# EasyEDA Pro project URADORRY-SUN.eprj, schematic Sub - MAX3421E/Rev1.0
Create Date: 2024-05-30; Page Name: base; Project Name: URADORRY-SUN; Schematic Name: Sub - MAX3421E/Rev1.0; Update Date: 2024-06-01; Add into BOM: yes; Company: 整数71の情報処理; Convert to PCB: yes; Drawed: 整数71
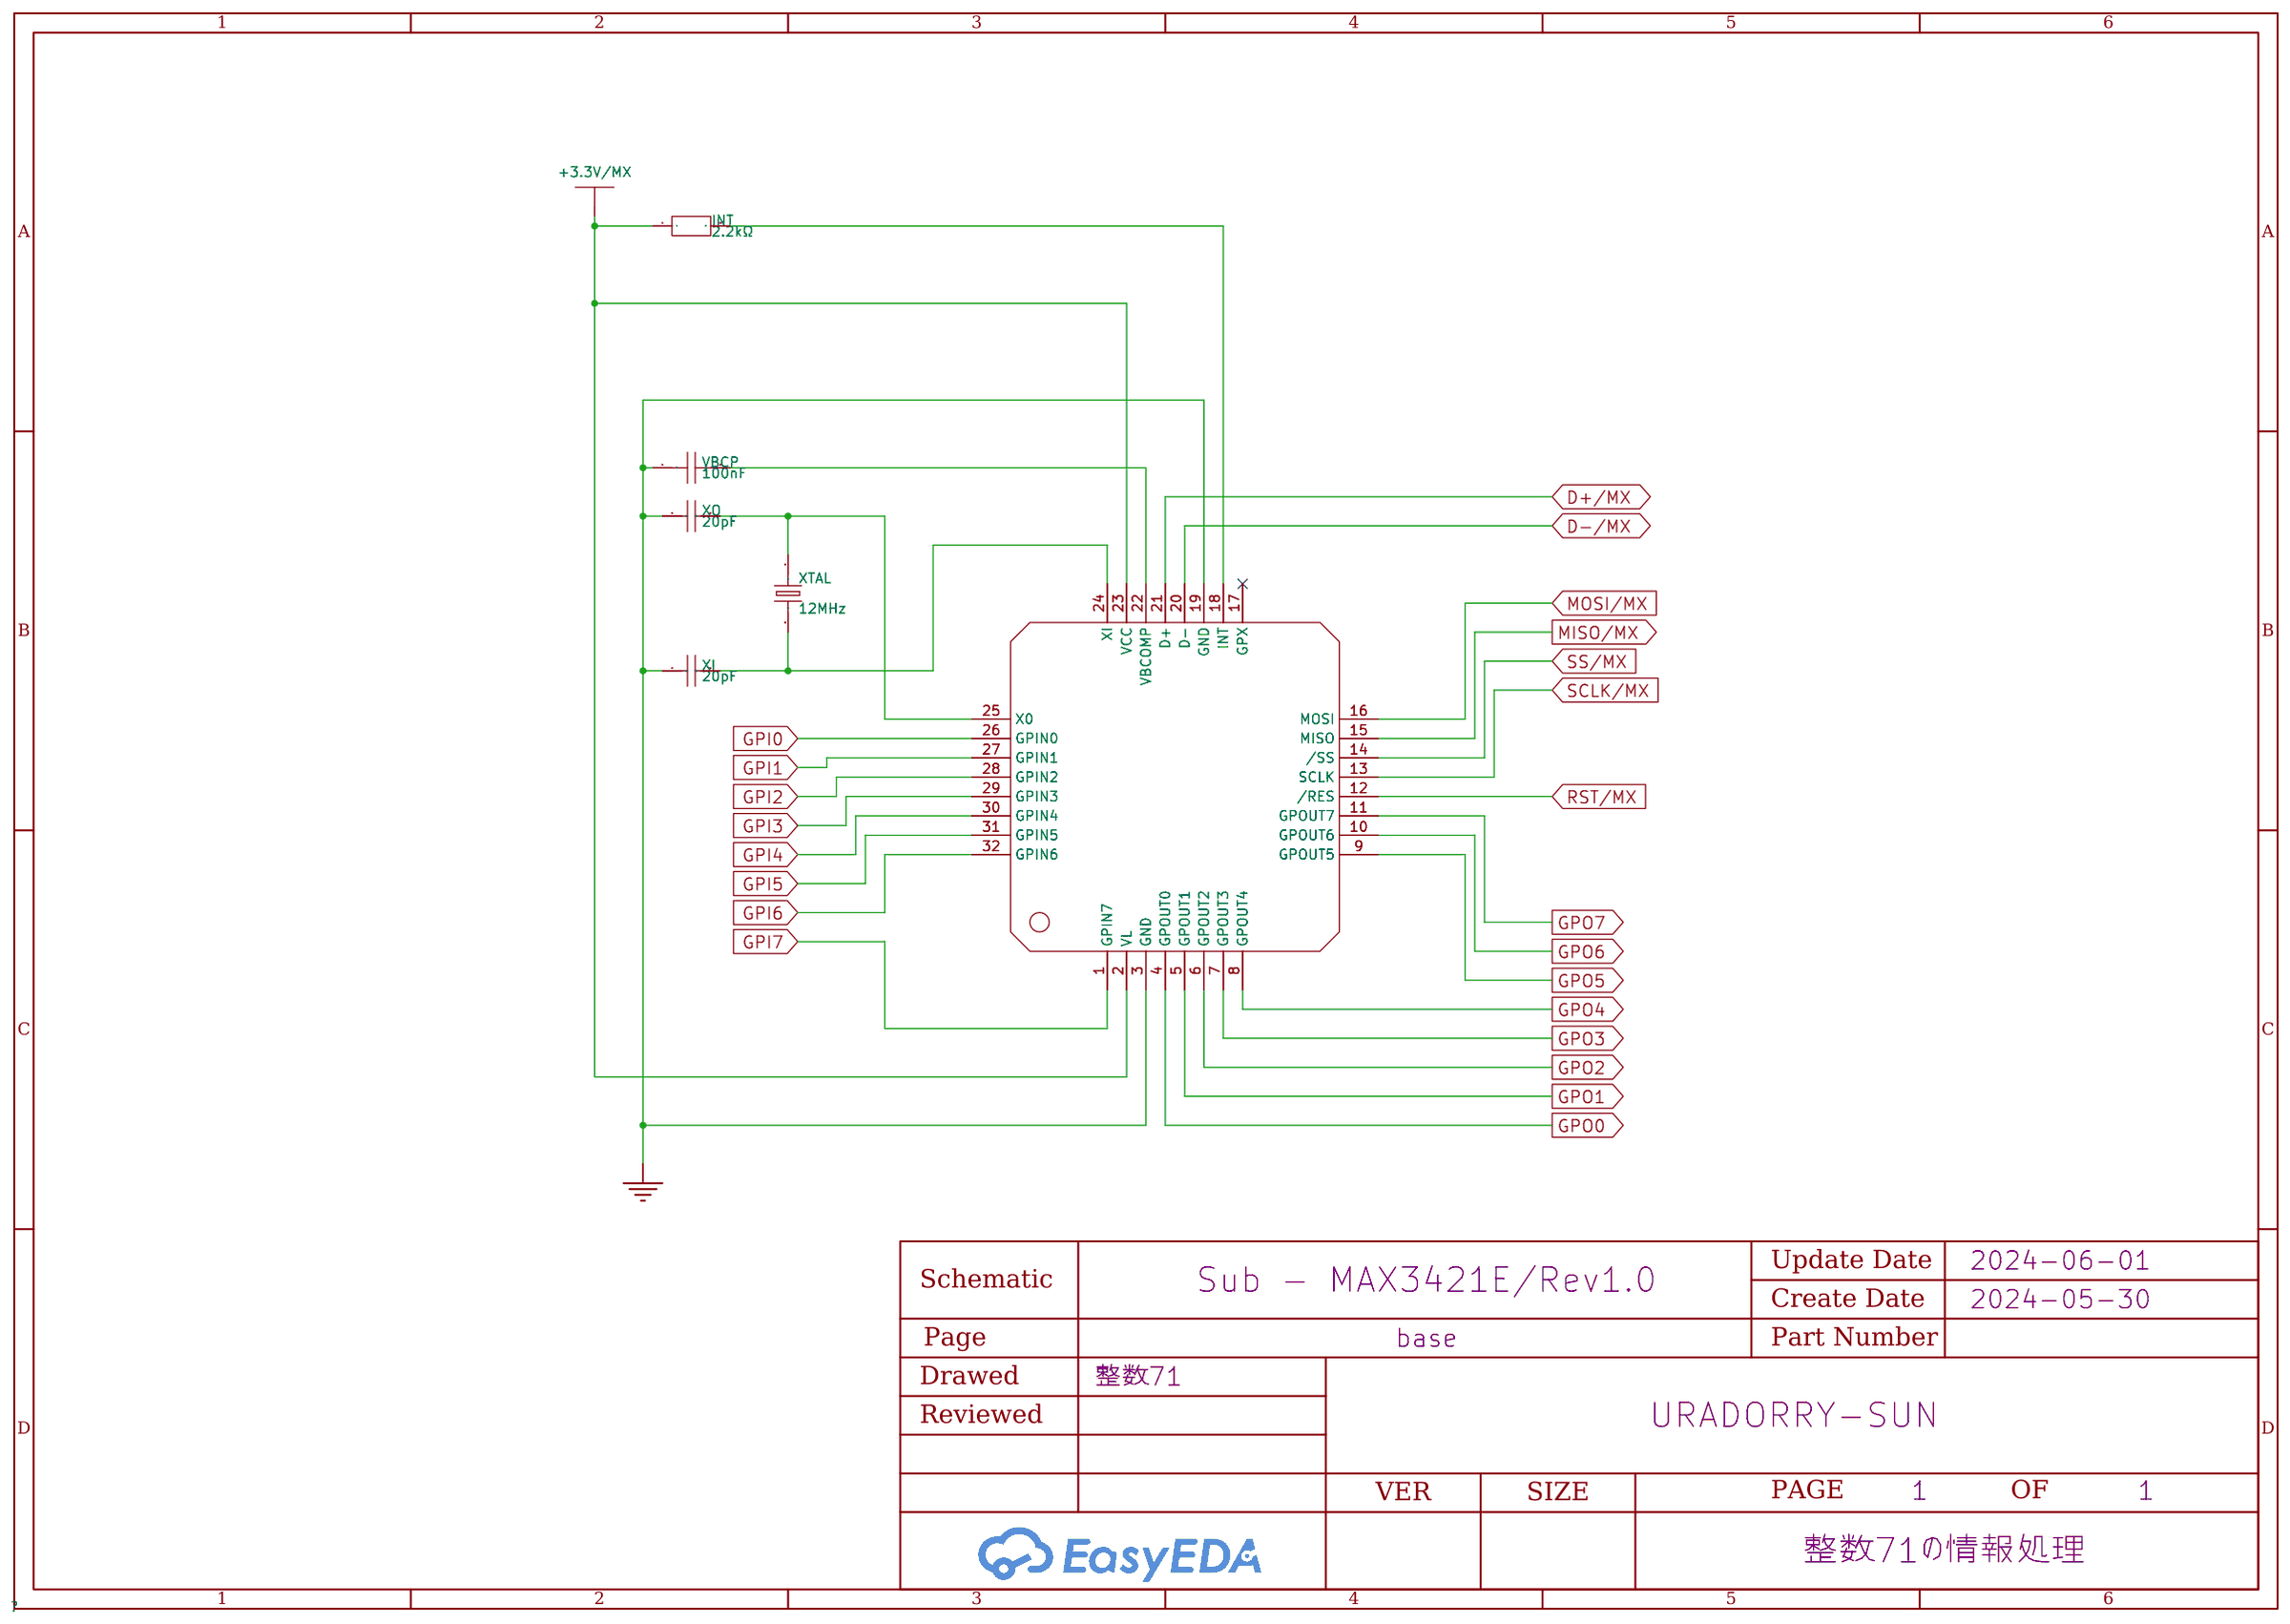
[diagram p1: schematic sheet]

## Parts
INT  2.2kΩ  [RES-TH_BD1.7-L3.5-P7.50-D0.5]
MAX3421E  MAX3421EEHJ+T  [TQFP-32_L5.0-W5.0-P0.50-LS7.0-BL]
VBCP  100nF  [CAP-TH_L5.8-W3.6-P5.0-D0.6]
XI  20pF  [CAP-TH_L5.0-W3.2-P5.08-D0.6]
XO  20pF  [CAP-TH_L5.0-W3.2-P5.08-D0.6]
XTAL  12MHz  [HC-49US_L11.5-W4.5-P4.88]

## Library data of the parts
INT = 2.2kΩ(Plugin 3.5mm): Type:Metal Film Resistors Resistance: Tolerance:±1% Tolerance:±1% Overload Voltage (Max):150V Power(Watts):125mW Temperature Coefficient:±50ppm/℃ Temperature Coefficient:±50ppm/℃ Operating Temperature Range:-55℃~+125℃ Operating Temperature Range:-55℃~+125; LCSC Part Name: 2.2kΩ ±1% 125mW 金属膜电阻; Supplier Part: C433486; Manufacturer: Tyohm(幸亚电阻); Manufacturer Part: RN 1/8W 2K2 F T/B A1; Supplier Footprint: 插件,D1.7xL3.5mm; JLCPCB Part Class: Extended Part; Datasheet: https://atta.szlcsc.com/upload/public/pdf/source/20191008/C433681_B72693A7FD256E0D1DC5EFE3F095EED3.pdf; Supplier: LCSC; Type: Metal Film Resistors; Tolerance: ±1%; Overload Voltage (Max): 150V; Power(Watts): 125mW; Temperature Coefficient: ±50ppm/℃; Operating Temperature Range: -55℃~+125℃
MAX3421E = MAX3421E(TQFP-32): Applications Function: Protocol:SPI Supply Voltage:3V~3.6V Supply Voltage:3V~3.6V Operating Temperature:-40℃~+85℃ Operating Temperature:-40℃~+85℃; Supplier Part: C2651881; Manufacturer: ADI(亚德诺)/MAXIM(美信); Supplier Footprint: TQFP-32(5x5); JLCPCB Part Class: Extended Part; Datasheet: https://atta.szlcsc.com/upload/public/pdf/source/20210605/F813BE6628303343E236A60FF1C5CBC3.pdf; Supplier: LCSC; Protocol: SPI; Supply Voltage: 3V~3.6V; Operating Temperature: -40℃~+85℃
VBCP = 100nF(Plugin 5.08mm): Capacitance: Tolerance:±10% Tolerance:±10% Voltage Rated: Temperature Coefficient:; Supplier: LCSC; Supplier Part: C5632426; Manufacturer: KNSCHA(科尼盛); Manufacturer Part: 178MU0002; JLCPCB Part Class: Extended Part; LCSC Part Name: 100nF ±10% 50V; Supplier Footprint: 插件,P=5.08mm; Datasheet: https://atta.szlcsc.com/upload/public/pdf/source/20230506/08E784E6BF236BA57EBA91152AC3AC6D.pdf; Tolerance: ±10%
XI XO = 20pF(Plugin 5.08mm): Capacitance: Tolerance:±5% Tolerance:±5% Voltage Rated: Temperature Coefficient:NP0; Supplier: LCSC; Supplier Part: C2761744; Manufacturer: Dersonic(德尔创); Manufacturer Part: CD1H200JC9BECHD100; JLCPCB Part Class: Extended Part; LCSC Part Name: 20pF ±5% 50V; Supplier Footprint: 插件,P=5.08mm; Datasheet: https://atta.szlcsc.com/upload/public/pdf/source/20210512/C2761744_B1A0D4C027D843B54401A3CD3D312F15.pdf; Tolerance: ±5%; Temperature Coefficient: NP0
XTAL = 12MHz - 20pF(HC-49S): Crystal Type:直插晶振 Frequency:12MHz Normal temperature Frequency Tolerance:±20ppm Normal temperature Frequency Tolerance:±20ppm External load capacitor: Frequency Stability(Full temperature range):±30ppm Frequency Stability(Full temperature range):±30ppm Op; LCSC Part Name: 12MHz ±20ppm 20pF; Supplier Part: C5143389; Manufacturer: YJX(雅晶鑫); Manufacturer Part: TAXD12M2GLDBET8S; Supplier Footprint: HC-49S; JLCPCB Part Class: Extended Part; Datasheet: https://atta.szlcsc.com/upload/public/pdf/source/20220824/B921D61247B0A126BFC7E333D6DF00F3.pdf; Supplier: LCSC; Crystal Type: 直插晶振; Normal temperature Frequency Tolerance: ±20ppm; Frequency Stability(Full temperature range): ±30ppm

## Nets
GND: MAX3421E.3(GND) MAX3421E.19(GND) VBCP.1 XI.1 XO.1
+3.3V/MX: INT.1 MAX3421E.2(VL) MAX3421E.23(VCC)
D+/MX: MAX3421E.21(D+)
D-/MX: MAX3421E.20(D-)
GPI0: MAX3421E.26(GPIN0)
GPI1: MAX3421E.27(GPIN1)
GPI2: MAX3421E.28(GPIN2)
GPI3: MAX3421E.29(GPIN3)
GPI4: MAX3421E.30(GPIN4)
GPI5: MAX3421E.31(GPIN5)
GPI6: MAX3421E.32(GPIN6)
GPI7: MAX3421E.1(GPIN7)
GPO0: MAX3421E.4(GPOUT0)
GPO1: MAX3421E.5(GPOUT1)
GPO2: MAX3421E.6(GPOUT2)
GPO3: MAX3421E.7(GPOUT3)
GPO4: MAX3421E.8(GPOUT4)
GPO5: MAX3421E.9(GPOUT5)
GPO6: MAX3421E.10(GPOUT6)
GPO7: MAX3421E.11(GPOUT7)
INT: INT.2 MAX3421E.18(INT)
MISO/MX: MAX3421E.15(MISO)
MOSI/MX: MAX3421E.16(MOSI)
RST/MX: MAX3421E.12(/RES)
SCLK/MX: MAX3421E.13(SCLK)
SS/MX: MAX3421E.14(/SS)
VBCP: MAX3421E.22(VBCOMP) VBCP.2
XI: MAX3421E.24(XI) XI.2 XTAL.2
XO: MAX3421E.25(X0) XO.2 XTAL.1

Not connected (* = marked no-connect by the designer): MAX3421E 17(GPX)*
